# EasyEDA Pro project Jarvis.eprj, schematic Schematic7
Board Name: SystemClock; Create Date: 2026-04-16; Page Name: P1; Project Name: Jarvis; Schematic Name: Schematic7; Update Date: 2026-04-16; Company: EasyEDA.com; Page Size: A4; Version: V1.0
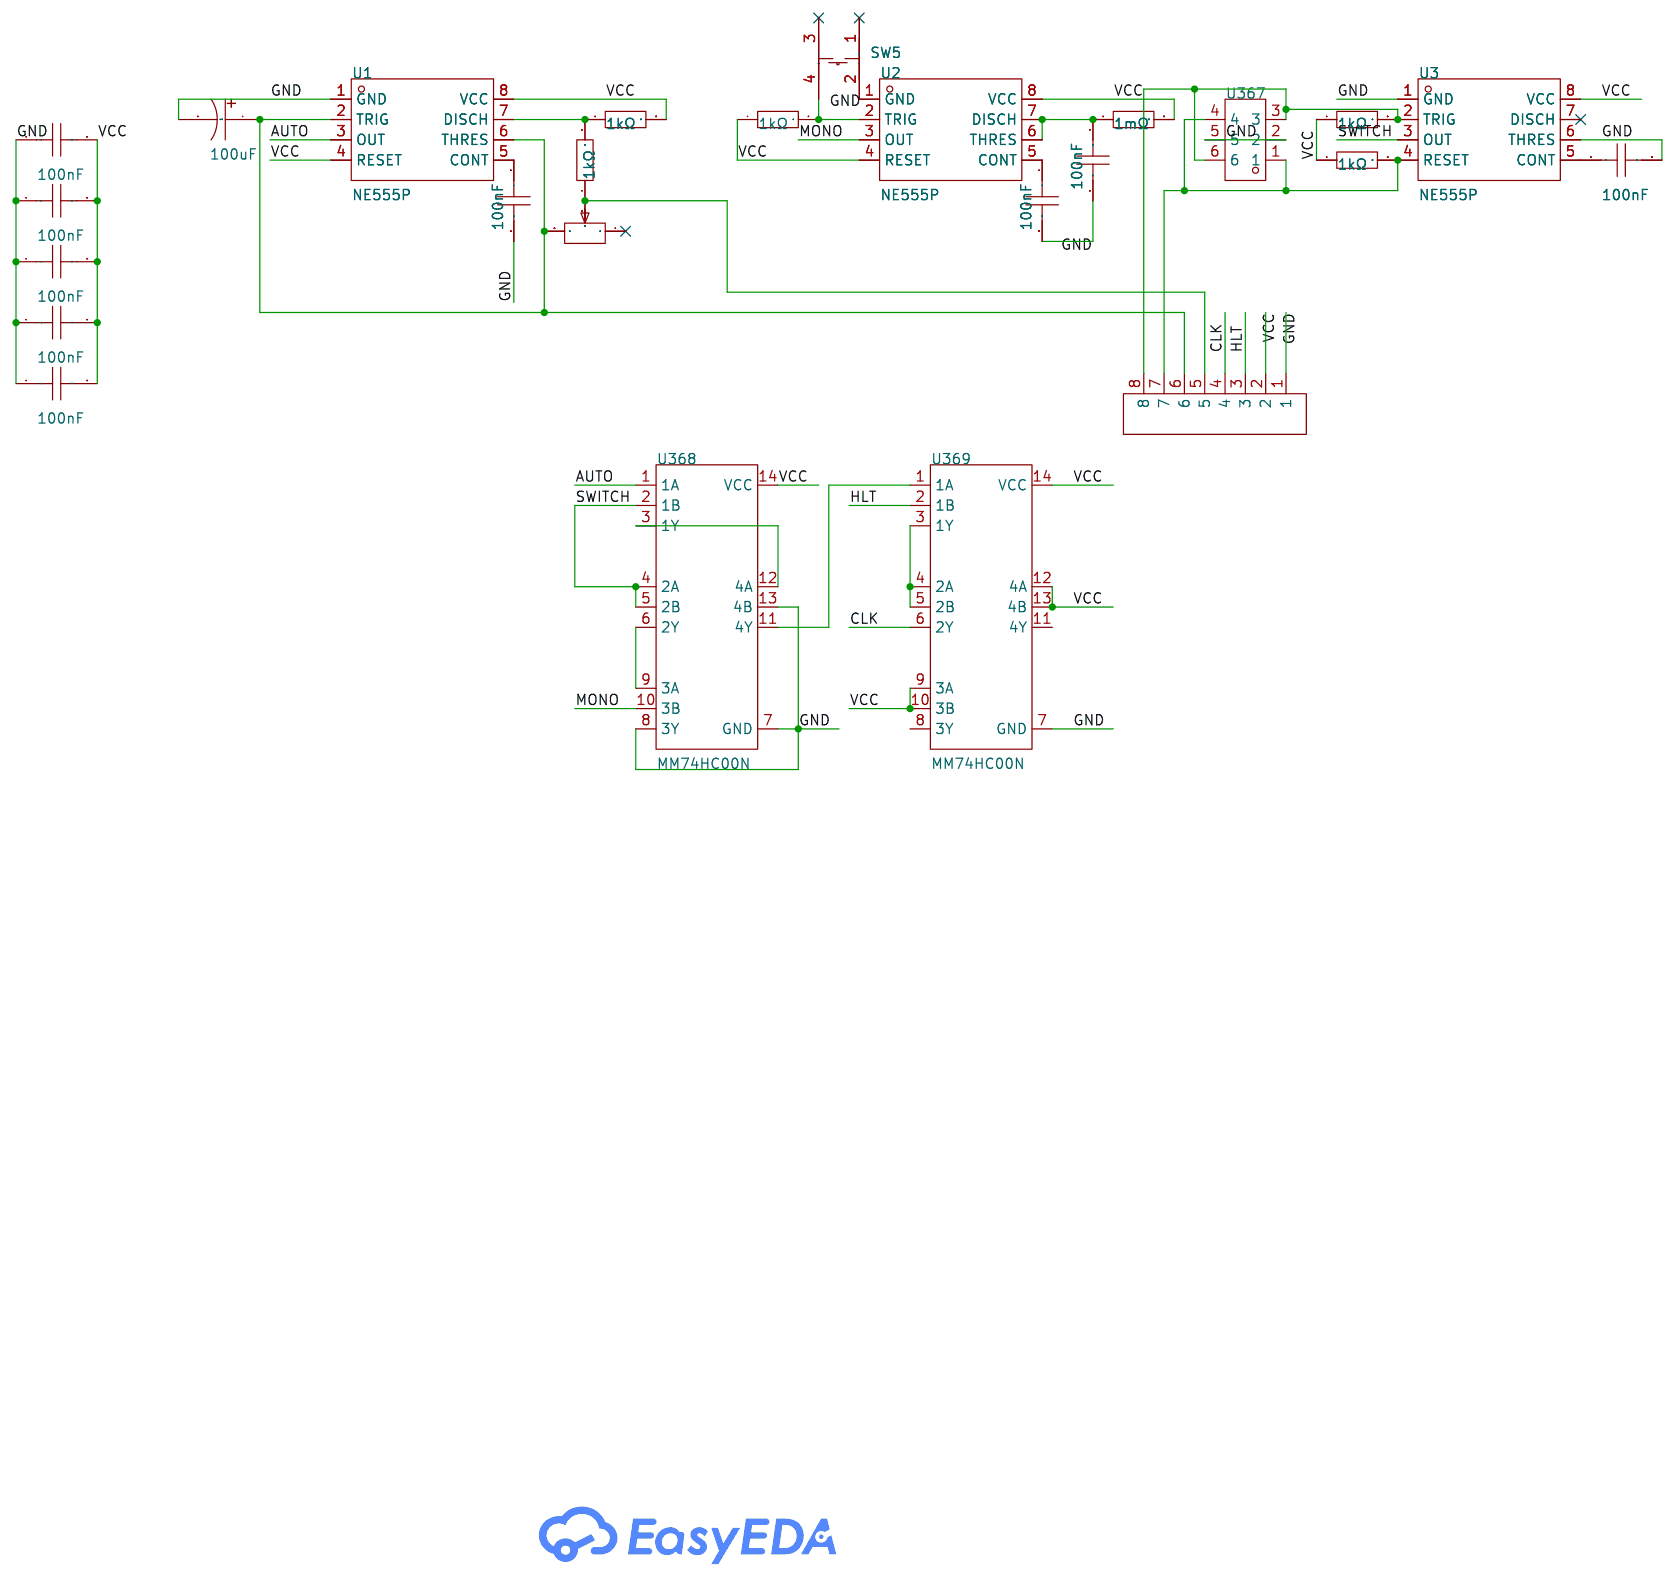
[diagram p6: schematic sheet]

## Parts
C40  100uF  [CAP-TH_BD6.3-P2.50-D1.0-FD]
C65  100nF  [CAP-TH_L5.0-W2.5-P5.00-D1.0]
C66  100nF  [CAP-TH_L5.0-W2.5-P5.00-D1.0]
C67  100nF  [CAP-TH_L5.0-W2.5-P5.00-D1.0]
C68  100nF  [CAP-TH_L5.0-W2.5-P5.00-D1.0]
C69  100nF  [CAP-TH_L5.0-W2.5-P5.00-D1.0]
C70  100nF  [CAP-TH_L5.0-W2.5-P5.00-D1.0]
C71  100nF  [CAP-TH_L5.0-W2.5-P5.00-D1.0]
C72  100nF  [CAP-TH_L5.0-W2.5-P5.00-D1.0]
C73  100nF  [CAP-TH_L5.0-W2.5-P5.00-D1.0]
PR1  -  [RES-ADJ-TH_3362P]
R60  1kΩ  [RES-TH_BD2.3-L6.5-P10.50-D0.5]
R61  1kΩ  [RES-TH_BD2.3-L6.5-P10.50-D0.5]
R62  1mΩ  [RES-TH_BD2.3-L6.5-P10.50-D0.5]
R63  1kΩ  [RES-TH_BD2.3-L6.5-P10.50-D0.5]
R64  1kΩ  [RES-TH_BD2.3-L6.5-P10.50-D0.5]
R65  1kΩ  [RES-TH_BD2.3-L6.5-P10.50-D0.5]
SW5  B3F-1000-S  [KEY-TH_4P-L6.2-W6.2-P4.50-LS6.5]
U1  NE555P  [DIP-8_L9.8-W6.6-P2.54-LS7.6-BL]
U2  NE555P  [DIP-8_L9.8-W6.6-P2.54-LS7.6-BL]
U3  NE555P  [DIP-8_L9.8-W6.6-P2.54-LS7.6-BL]
U367  KEY_8*8  [KEY-TH_6P-L7.1-W7.1-P2.00]
U368  MM74HC00N  [PDIP-14_L19.3-W6.4-P2.54-LS9.0-BL]
U369  MM74HC00N  [PDIP-14_L19.3-W6.4-P2.54-LS9.0-BL]
U388  TH2.54_8P_0.6  [HDR-TH_8P-P2.54-V-M-3]

## Library data of the parts
C40 = NXA35VB100M6.3*11_LO: LCSC Part Name: 100uF 35V; Supplier Part: C346956; Supplier Footprint: 插件,6.3x11mm; JLCPCB Part Class: Extended Part; Supplier: LCSC
C65-C73 = 178MU0006: LCSC Part Name: 100nF ±10% 50V; Supplier Part: C5632430; Manufacturer: KNSCHA(科尼盛); Supplier Footprint: 插件,P=2.54mm; JLCPCB Part Class: Extended Part; Datasheet: https://item.szlcsc.com/datasheet/178MU0006/6552585.html; Supplier: LCSC; Tolerance: ±10%; Voltage Rating: 50V; Temperature Coefficient: X7R; Pin Spacing: 2.54mm
PR1 = 环保 3362P-1-503LF: LCSC Part Name: 50KΩ; Supplier Part: C5054; Supplier Footprint: VR-3362P; JLCPCB Part Class: Extended Part; Supplier: LCSC
R60-R65 = MF1/4W-1KΩ±1%T52: Type:Metal Film Resistors Resistance: Tolerance:±1% Tolerance:±1% Power(Watts):250mW Temperature Coefficient:±200ppm/℃ Temperature Coefficient:±200ppm/℃; LCSC Part Name: 金属膜电阻 1kΩ ±1% 250mW; Supplier Part: C713997; Manufacturer: 华星机电; Supplier Footprint: 插件,D2.3xL6.5mm; JLCPCB Part Class: Extended Part; Datasheet: https://atta.szlcsc.com/upload/public/pdf/source/20200731/C713882_AE8EB1102749D7E4FB4FB13DC898C429.pdf; Supplier: LCSC; Type: Metal Film Resistors; Tolerance: ±1%; Power(Watts): 250mW; Temperature Coefficient: ±200ppm/℃
SW5 = B3F-1000-S: Supplier Part: C19724130; Manufacturer: OMRON(欧姆龙); Supplier Footprint: SW-TH_4P; JLCPCB Part Class: Extended Part; Datasheet: https://item.szlcsc.com/datasheet/B3F-1000-S/21045793.html; Supplier: LCSC
U1-U3 = NE555P: Supplier Part: C46749; Manufacturer: TI(德州仪器); Supplier Footprint: DIP-8; Datasheet: https://www.ti.com/cn/lit/gpn/ne555; Supplier: LCSC
U367 = KEY_8*8: Supplier Part: C9900001793; Supplier Footprint: SW-TH_6P-L7.1-W7.1-P2.00-LS4.9; JLCPCB Part Class: Extended Part; Supplier: LCSC
U368 U369 = MM74HC00N: Supplier Part: C4472810; Manufacturer: TI(德州仪器); Supplier Footprint: DIP-14; JLCPCB Part Class: Extended Part; Datasheet: https://atta.szlcsc.com/upload/public/pdf/source/20230920/AE4EE648A4D81869CF07AF2DDCC9D708.pdf; Supplier: LCSC; Logic Type: NAND Gate; Number of Channels: 4; Voltage - Supply: 2V~6V; Quiescent Current: 2uA; Current - Output Low(IOL): 5.2mA; Current - Output High(IOH): 5.2mA; Input Logic Level - High: 1.5V~4.2V; Series: 74HC Series; Propagation Delay: 15ns@6V,50pF; Operating Temperature: -40℃~+85℃
U388 = TH2.54_8P_0.6: Supplier Part: C9900018349; Supplier Footprint: HDR-TH-8P; JLCPCB Part Class: Extended Part; Supplier: LCSC

## Nets
GND: C40.2 C65.2 C66.2 C67.2 C68.2 C69.1 C70.1 C71.1 C72.1 C73.1 SW5.2 U1.1(GND) U2.1(GND) U3.1(GND) U3.6(THRES) U367.2 U367.5 U368.7(GND) U369.7(GND) U388.1
VCC: C69.2 C70.2 C71.2 C72.2 C73.2 R60.2 R62.2 R63.1 R64.1 R65.1 U1.4(RESET) U1.8(VCC) U2.4(RESET) U2.8(VCC) U3.8(VCC) U368.14(VCC) U369.9(3A) U369.10(3B) U369.12(4A) U369.13(4B) U369.14(VCC) U388.2
AUTO: U1.3(OUT) U368.1(1A)
CLK: U369.6(2Y) U388.4
HLT: U369.2(1B) U388.3
MONO: U2.3(OUT) U368.10(3B)
SWITCH: U3.3(OUT) U368.2(1B) U368.4(2A) U368.5(2B)
$1N254: R60.1 R61.2 U1.7(DISCH)
$1N384: PR1.2 R61.1 U388.5
$1N388: C40.1 PR1.3 U1.2(TRIG) U1.6(THRES) U388.6
$1N429: C65.1 U1.5(CONT)
$1N627: C66.1 R62.1 U2.6(THRES) U2.7(DISCH)
$1N721: C67.1 U2.5(CONT)
$1N762: R63.2 SW5.4 U2.2(TRIG)
$1N925: C68.1 U3.5(CONT)
$1N1404: R65.2 U3.2(TRIG) U367.3 U367.6 U388.8
$1N1418: R64.2 U3.4(RESET) U367.1 U367.4 U388.7
$1N1718: U368.6(2Y) U368.9(3A)
$1N1722: U368.3(1Y) U368.12(4A)
$1N1732: U368.8(3Y) U368.13(4B)
$1N1744: U368.11(4Y) U369.1(1A)
$1N1775: U369.3(1Y) U369.4(2A) U369.5(2B)

Not connected (* = marked no-connect by the designer): PR1 1*; SW5 1* 3*; U3 7(DISCH)*; U369 8(3Y) 11(4Y)
